# EAGLE board Backplane (EAGLE 7.2.0), part 2 of 2
## Tracks (layer width: path | path; a pad name or v marks a point on that pad's centre or on a via)
1AVAL
  Top 0.254: C22.1 59.97,39.79 R42.1 59.99,40.82 60.45,41.27 66.17,41.27 66.8,41.91 U1.41
2AVAL
  Top 0.254: C24.1 54.1,39.81 R28.1 54.15,41.07 54.99,41.91 65.53,41.91 66.04,42.42 66.04,47.98 U1.40
3AVAL
  Top 0.254: C14.1 65.13,39.79 R7.1 66.91,39.86 67.56,40.51 67.56,47.98 U1.42
+5V  (via drill 0.5, 0.6)
  Top 0.203: v69.95,39.85 70.38,40.03 U13.16 70.38,41.2 70.41,41.17 70.41,41.27 70.31,41.38 70.31,41.07 | 82.07,41.38 81.97,41.28 U14.16 80.7,41.28 v80.59,41.17 | U15.16 94.39,41.28 v94.34,41.22 | U2.8 58.19,79.05 58.37,79.22 v58.37,79.73
  Top 0.254: 34.27,139.24 R49.2 34.27,141.65 R11.2 | U1.28 61.35,53.82 C10.1 61.82,56.06 v61.87,56.11 | U1.7 69.1,54.62 68.94,54.79 68.94,56.26 v68.58,56.62 | R1.2 121.64,54.13 v121.92,53.85 | U3.8 133.58,73.89 v134.49,74.8 | v114.53,34.59 114.53,34.57
  Top 0.305: 34.27,139.24 33.12,139.24 v32.49,139.88 | 34.27,141.65 34.02,141.65 33.88,141.78 | R17.2 42.4,140.88 v42.27,141.02 | R4.2 R3.2 78.83,80.97 v78.79,81
  Bottom 0.203: 80.64,41.12 v80.59,41.17 81,41.58 C16.1 | 94.34,41.12 v94.34,41.22 94.69,41.58 C21.1 | v61.87,56.11 61.87,54.34 C10.1
  Bottom 0.254: v68.58,56.62 68.58,54.95 C11.1 | v121.92,53.85 121.92,53.59 | C15.1 70.07,39.74 v69.95,39.85 | R2.2 76.9,61 JP1.2 | v134.49,74.8 134.49,73.09 C20.1 | U11.8 114.28,34.42 v114.53,34.59 114.82,34.79 C5.1
  Bottom 0.305: v32.49,139.88 32.49,140.13 | v42.27,141.02 42.27,141.15 | v78.79,81 78.79,81.05
  other vias: 139.32,121.18 139.32,119.1 139.32,117.07 139.32,115.04 139.32,112.95 135.25,121.18
  pour Route15 (rank 4): 0,0 142.24,0 142.24,162.56 0,162.56
  pour Top: 139.42,111.84 135.71,111.84 135.51,112.04 135.51,118.19 134.85,118.85 133.99,118.85 133.63,119.2 133.63,121.49 134.19,122.05 139.57,122.05 140.18,121.44 140.18,112.65
  pour Top: 134.7,121.67 134.7,125.22 135.2,125.73 139.01,125.73 139.52,125.22 139.52,121.92 139.27,121.67
+9V  (via drill 0.6)
  Top 0.203: v127.31,91.44 122.53,91.44 121.74,90.65 121.74,80.85 120.6,79.7 88.88,79.7 88.44,80.14 88.44,80.62 v88.42,80.64
  Top 0.254: 138.68,94.29 U9.6 | v136.53,95.76 136.53,95.89 136.4,96.01 | R25.2 117.86,58.59 v117.35,59.11
  Bottom 0.203: 120.55,60.3 120.55,72.57 119.36,73.76 105.61,73.76 104.39,72.54 85.67,72.54 85.29,72.92 85.27,75.06 86.11,75.89 86.11,78.13 88.42,80.44 v88.42,80.64 | R40.1 133.94,92.97 132.94,91.97 127.84,91.97 v127.31,91.44
  Bottom 0.254: R40.1 135.2,95.2 135.51,95.5 136.27,95.5 v136.53,95.76 | v117.35,59.11 119.36,59.11 120.55,60.3
  other vias: 115.54,149.68 22.3,139.09 22.25,137.46 22.2,135.79
  pour Top: 24.97,142.24 21.44,142.34 21.31,134.34 24.99,134.39
  pour Top (rank 2): 114.15,156.77 23.34,156.77 21.18,154.61 21.18,142.42 22.07,141.53 24.87,141.53 25.25,141.91 25.25,151.43 27.41,153.59 111.1,153.72
  pour Top (no thermals): 135.89,94.61 135.89,98.81 133.73,100.97 124.21,100.97 123.57,101.6 123.57,144.78 120.52,147.83 120.52,152.02 121.95,152.12 126.87,146.81 126.87,104.9 127.64,104.14 138.68,104.14 140.84,101.98 140.84,88.52 140.34,88.01 136.65,88.01 135.51,89.15 135.51,94.23
  pour Top (no thermals): 135.31,107.75 135.31,102.95 135.41,102.84 137.67,102.84 137.72,102.79 137.72,107.47 137.21,107.98 135.53,107.98
  pour Top: 111.1,153.8 111.23,148.01 113.18,147.93 120.6,147.93 120.65,147.88 120.65,151.51 121.26,152.12 115.37,152.12 115.34,156.72 114.02,156.72 113.89,156.74
  pour Bottom: 21.18,137.46 21.18,118.97 22.25,117.91 23.01,117.91 23.62,117.3 23.62,93.57 24.49,92.71 26.06,92.71 26.52,93.17 26.52,118.47 25.2,119.79 23.93,119.79 23.47,120.24 23.47,139.09 22.86,139.7 21.54,139.7 21.18,139.34
+24V  (via drill 0.6)
  Top 0.254: R15.2 124.63,58.59 124.97,58.93 124.97,72.14 124.71,72.39 | R14.2 54.32,69.05 JP3.1
  Top 0.61: v137.26,10.39 135.48,10.39 134.21,11.66 134.21,16.74 v134.59,17.12
  Top 0.813: v37.36,67.33 37.36,54.36 v37.16,54.15 | 108.71,70.51 U12.2
  Top 1.016: K1.A1 41.31,44.7 39.29,46.71 39.29,52.02 v37.16,54.15
  Top 1.27: v106.45,71.07 106.5,71.35 106.63,73.03 106.05,71.93 105.77,73.41 105.33,73.84 | v125.68,73.15 125.58,73.15
  Bottom 0.254: 128.5,27.91 128.5,28.78 Q7.1 | R63.2 134.75,26.75 133.83,25.83
  Bottom 0.61: D8.C 35.04,67.14 35.23,67.33 v37.36,67.33 | U7.6 138.91,9.75 138.71,9.96 137.69,9.96 v137.26,10.39 | v134.59,17.12 134.59,25.07 133.83,25.83 129.26,25.83 128.52,26.57 128.52,27.89 128.5,27.91
  Bottom 0.813: K7.A3 v37.16,54.15 35.15,54.15 | 35.15,54.15 35.15,56.07 D5.C | D7.C 35.04,54.04 35.15,54.15 | K8.A3 34.9,67.36 | 34.9,67.36 34.9,65.47 D8.C | 34.9,67.36 34.9,69.25 D6.C
  Bottom 1.016: D1.C 39.22,43.74 40.31,44.83 41.99,44.83 K1.A1
  Bottom 1.27: K8.A3 43.54,67.36 45.19,69.01 47.95,69.01 JP4.1 JP3.1 85.62,69.14 88.11,71.02 105.72,71.02 v106.45,71.07 | Q7.2 Q7.1 127.61,28.85 126.9,29.57 126.9,67.46 125.75,68.61 125.75,73.08 v125.68,73.15
  pour Top (no thermals): 104.52,75.82 104.52,69.72 105.03,69.22 115.19,68.83 115.82,69.47 115.82,71.63 116.84,72.14 117.86,72.14 119.25,72.01 130.81,72.01 131.57,73.15 131.57,77.85 130.18,78.99 107.95,78.74
  pour Bottom: 128.12,30.12 131.01,30.12 131.22,29.92 131.22,27.58 131.14,27.51 128.07,27.51 127.94,27.64 127.94,29.95
AIR-BOT+PRE
  Top 0.254: R19.2 26.86,23.94 26.54,23.62 26.54,21.59 26.42,21.46 26.09,21.46 U6.16
  pour Top (no thermals): 23.88,21.84 26.42,21.84 27.3,20.95 27.3,12.19 24.38,12.19 23.88,12.7
AIR-P
  pour Bottom (no thermals): 52.2,26.42 46.23,26.42 44.58,24.77 44.58,21.08 45.59,20.07 46.74,18.8 47.37,18.16 47.37,13.46 45.97,12.57 44.7,12.7 44.45,12.7 44.45,17.27 43.56,18.54 43.56,28.19 45.09,29.46 52.2,29.46 52.58,29.08 52.58,26.8
AIR-TOP
  Top 0.254: R18.2 20.05,24.02 20.83,23.24 20.83,21.72 21.08,21.46
  pour Top (no thermals): 20.07,12.19 23.11,12.19 23.62,12.7 23.62,21.59 23.37,21.84 20.95,21.84 20.07,20.95
AMD-SEN
  Top 0.254: J1.17 21.65,2.73 21.21,2.29 3.17,2.29 2.29,3.17 2.29,50.29 2.79,50.8 3.43,50.8 3.68,51.05 3.68,52.7 3.05,53.34 3.05,65.02 4.19,66.17 4.19,67.94 3.68,68.45 3.68,98.68 4.32,99.31 20.19,99.31 22.1,101.22 22.1,102.23 22.61,102.74 95,102.74 97.54,105.28 97.54,107.97 U$6.28
B-LIGHT  (via drill 0.6)
  Top 0.254: R61.2 124.38,26.82 125.32,25.88 126.62,25.88 v126.85,25.65
  Bottom 0.254: v126.85,25.65 126.85,23.9 127.13,23.62 Q7.8 | Q7.6 131.52,23.62 131.66,23.76 | Q7.5 131.83,23.62 131.78,23.57
  Bottom 1.676: J2.23 125.5,9.73 128.29,12.52 128.29,22.02 128.88,22.61 131.7,22.61 131.78,22.53 131.78,23.57 131.78,23.65 131.66,23.76 131.6,23.82 129.49,23.82 | Q7.8 128.63,23.82 129.49,23.82 | 129.49,23.82 Q7.7
B-LIGHT-C  (via drill 0.6)
  Top 0.254: U$1.24 87.35,79.78 87.91,79.22 102.59,79.22 103.73,78.08 103.73,74.02 v103.35,73.64
  Bottom 0.254: QE4.1 131.31,34.9 R62.2 131.33,43.83 133.25,45.74 133.25,64.19 129.69,67.74 129.69,74.3 128.8,75.18 104.9,75.18 v103.35,73.64
BMS-P
  pour Top (no thermals): 78.49,12.83 78.49,22.73 80.39,24.64 84.33,24.64 84.71,24.26 84.71,21.59 83.57,20.32 82.3,20.32 81.79,19.81 81.79,12.7 81.03,12.06 79.25,12.06
BOTS-SEN
  Top 0.254: J1.16 17.65,3.55 17.02,2.92 3.56,2.92 2.92,3.56 2.92,49.78 3.3,50.16 3.68,50.16 4.19,50.67 4.19,53.09 3.68,53.59 3.68,64.52 4.95,65.79 4.95,68.2 4.45,68.71 4.45,97.92 5.08,98.55 20.7,98.55 24.26,102.11 97.16,102.11 100.08,105.03 100.08,107.97 U$6.29
BPD-R-SET  (via drill 0.6)
  Top 0.254: v26.34,68.38 10.92,68.38 10.26,69.04 10.26,70.99 9.83,71.42 9.83,87.33 10.11,87.61 21.13,87.61 25.32,91.8 25.32,94 26.62,95.3 88.77,95.33 v89.05,95.05
  Bottom 0.254: R34.2 v26.34,68.38 | v89.05,95.05 88.95,95.17 88.62,95.3 88.62,109.27 U$6.57
BPD-SEN  (via drill 0.5, 0.6)
  Top 0.203: K8.22 26.83,64.36 25.58,65.61 v12.88,65.61
  Top 0.254: U$6.23 84.81,106.27 82.8,104.27 21.08,104.27 20.32,103.5 20.32,101.98 19.18,100.84 3.68,100.84 2.16,99.31 2.16,67.56 v2.67,67.06
  Bottom 0.254: v2.67,67.06 11.38,67.06 | 11.38,67.06 11.51,67 | 11.38,67.06 11.53,66.95 v12.88,65.61
CLEAR  (via drill 0.5)
  Top 0.203: U15.10 103.15,39.12 v103.17,39.09 | v89.59,38.84 89.59,41.26 U14.10 | U13.10 78,38.91 v78.03,38.89
  Bottom 0.203: v103.17,39.09 103.12,38.84 v89.59,38.84 v78.03,38.89
CLK  (via drill 0.5)
  Top 0.203: U15.11 101.88,38.05 v101.8,37.97 | U14.11 88.27,41.26 v88.27,37.97 88.27,37.31 88.06,37.11 86.33,37.11 85.88,37.57 77.01,37.57 | U13.11 76.73,37.85 77.01,37.57 | 77.01,37.57 76.91,37.57
  Top 0.254: 76.71,41.66 76.73,41.63 U13.11 76.45,41.51 76.45,49.78 73.22,53.02 U1.5
  Bottom 0.203: v101.8,37.97 v88.27,37.97
CSENSE  (via drill 0.6)
  Top 0.254: U3.7 135.76,72.14 v136.75,73.13 | v89.84,76.07 89.84,69.42 v90.12,69.14 | U1.19 63.7,59.72 63.7,63.73 64.9,64.92 81.64,64.92 82.6,65.89 82.6,66.93 v82.53,67
  Bottom 0.254: v136.75,73.13 136.75,77.11 136.17,77.7 131.65,77.7 131.62,77.72 91.49,77.72 v89.84,76.07 | v90.12,69.14 87.96,69.14 86.23,67.41 82.93,67.41 v82.53,67
DATA-IN
  Top 0.254: U13.14 72.9,41.26 72.9,42.42 73.91,43.43 73.91,49.02 72.31,50.62 U1.2
DDS-P
  pour Top (no thermals): 100.08,24.26 100.46,24.64 104.65,24.64 105.79,23.5 105.79,12.95 105.16,12.32 103.25,12.32 102.74,12.83 102.74,19.56 102.23,19.94 100.84,21.08 100.2,21.59 100.2,24.13
ECU-RELAY  (via drill 0.6)
  Top 0.254: v26.59,47.37 8.26,47.37 6.35,49.28 6.35,53.98 5.84,54.48 5.84,63.02 7.14,64.31 7.14,69.7 6.96,69.88 6.96,90.4 7.57,91.01 19.89,91.01 21.64,92.76 21.64,96.04 24.97,99.54 90.04,99.54 v90.45,99.92
  Bottom 0.254: R33.2 33.01,45.91 32.46,46.46 27.51,46.46 v26.59,47.37 | v90.45,99.92 90.45,92.08 91.14,91.39 91.14,88.92 U$1.25
ECU-SEN
  Top 0.203: 26.77,37.19 K1.22 28.52,38.94 28.52,51.54
  Top 0.254: 28.52,51.54 28.52,52.3 27.71,53.11 14.99,53.11 12.34,55.75 6.83,55.75 6.53,56.06 6.53,62.59 7.92,63.98 7.92,70.16 7.64,70.43 7.64,89.43 8.33,90.12 20.19,90.12 22.66,92.58 22.66,95.99 25.43,98.78 99.34,98.75 102.56,101.42 102.56,107.97 U$6.30
FAN
  pour Bottom (no thermals): 43.05,11.05 43.05,8.51 44.58,8 49.15,8.13 49.78,8.76 49.78,10.29 51.56,12.06 52.58,12.06 53.09,12.57 53.09,19.3 53.72,19.94 53.72,23.62 53.09,24.26 50.16,24.26 49.78,23.88 49.78,20.19 50.29,19.68 50.29,13.59 48.13,11.43 43.43,11.43
FROM-TSMS  (via drill 0.5, 0.6)
  Top 0.254: v54.97,92.84 52.58,92.84 52.4,92.66 28.14,92.66 27.53,92.05 27.53,83.67 v29.41,81.79 | v15.62,31.42 19.05,31.42 20.19,30.28 20.19,27.89 v20.45,27.64
  Bottom 0.254: U$6.12 56.87,105.99 55.42,104.55 55.42,93.29 v54.97,92.84 | v29.41,81.79 29.41,78.44 28.14,77.17 13.54,77.17 11.86,75.49 11.86,70.05 12.42,69.49 14.88,69.49 15.49,68.89 15.49,66.45 13.92,64.87 13.92,54.28 14.71,53.49 14.71,32.33 v15.62,31.42 | v20.45,27.64 20.62,27.64 20.73,27.74
  other vias: 22.86,24.38 23.75,23.88 22.86,23.37 24.64,24.38 24.64,23.37 25.53,23.88 21.97,23.88
  pour Bottom (no thermals): 28.19,13.21 28.19,18.03 26.92,19.3 19.56,19.3 19.05,19.81 19.05,27.43 19.81,28.19 30.23,28.19 30.99,27.43 30.99,12.95 28.45,12.95
GND  (via drill 0.5, 0.6)
  Top 0.203: v92.18,41.12 92.13,41.12 | U8.4 100.2,31.63 98.68,33.15 98.68,36.7 99.06,37.08 103.96,37.08 v104.34,37.47 | U10.4 85.21,34.67 85.09,34.8 85.09,36.7 84.71,37.08 81.03,37.08 80.77,36.83 80.77,35.94 v80.52,35.69 80.46,35.63 U13.8 | U14.8 92.45,35.68 v92.58,35.81 | U5.4 75.56,31.37 73.53,33.4 73.53,36.58 73.91,36.96
  Top 0.254: R51.1 36.3,140.39 v36.04,140.64 R16.1 | R48.1 46.2,140.26 46.46,140 47.98,140 v48.23,139.75 | v32.59,51.44 32.54,51.38 | v29.44,73.94 29.44,73.89 | U1.29 61.39,53.02 C10.2 61.82,50.72 v61.77,50.67 | U1.6 69.15,53.82 C11.2 68.43,51.28 v68.17,51.03 | v32.13,37.41 32.13,36.2 29.9,33.96 25.7,33.96 24.79,33.05 24.79,30.84 24,30.04 U6.4 | LED8.C 16.22,23.97 v15.88,23.62 | LED9.C 31.02,23.84 v31.37,23.5 | LED17.C 104.85,32.46 v104.9,32.51 | LED14.C 95.91,32.16 v96.01,32.26 | LED5.C v88.77,32 | LED4.C v81.28,32 | LED12.C LED10.C 63.21,22.95 63.63,23.37 64.24,23.37 v64.47,23.57 | VIN.C 121.67,64.96 5V.C 119.93,64.98 119.89,65.02 119.37,65.02 9V.C 118.04,64.96 v117.09,64.01 | VCCIO.C 109.47,58.42 108.46,57.4 108.46,52.99 U12.1 | v73.91,37.59 73.91,36.96 | LED6.C LED3.C | R54.1 48.27,58.41 48.01,58.67 | C14.2 63.16,37.97 R41.2 63.16,36.92 63.12,36.96 61.85,36.96 v61.72,37.08 | C22.2 57.99,37.01 | R57.2 57.99,35.73 57.99,37.01 | C24.2 52.09,35.73 R60.2 52.16,36.99 52.07,37.08 v50.8,37.08 | 57.99,37.01 57.91,37.08 v56.64,37.08 | U2.5 58.47,82.86 v58.67,82.65 | LED11.C 124.38,41.07 v124.41,41.1 | R13.1 60.73,63.01 C27.2 60.64,63.01 60.66,62.99 60.66,62.05 v61.24,61.47 | v106.5,24.23 106.5,24.28 106.53,24.31 | v115.24,37.74 115.24,37.77 115.27,37.8 | U12.3 99.72,65.53 | R8.1 10.8,39.89 C26.2 20.91,39.97 21.79,39.09 21.79,37.26 K1.21 | C25.2 38.9,25.2 R21.2 38.81,25.2 39.22,24.79 39.22,30.48 v39.37,30.63 | U15.8 104.42,37.39 v104.34,37.47
  Top 0.305: U3.5 135.64,69.6 v135.89,69.34 136.06,69.51 C28.2 | 104.44,37.36 v104.34,37.47 | LED3.C 45.8,54.36 v45.8,55.8
  Top 0.406: U12.3 99.52,65.58 99.34,65.53 99.24,65.43 | Q2.2 48.19,58.37 R54.1 | 48.27,58.41 48.27,60.95 47.88,61.34 45.77,61.34 v45.8,62.66 | v138.99,11.15 139.01,11.15 139.12,11.05
  Top 0.61: C4.C 88.04,159 v87.73,159.31 | v29.03,60.38 29.08,60.38 | v32.89,65.41 32.94,65.35 | Q1.2 52.13,59.88 52.2,60.07 | 52.2,60.07 v53.34,60.07 | R52.1 52.16,59.52 52.2,60.07
  Top 0.813: v36.85,44.42 36.85,44.48 36.91,44.53 | 105.33,49.07 105.89,48.51 106.17,48.79 106.17,49.02 106.12,49.07 C7.C | C12.C 132.28,126.11 v131.9,126.49 | C8.C 129.13,83.54 130.05,84.45 130.05,93.97 U9.1 | v131.95,96.67 131.95,96.01 130.3,94.36
  Top 1.016: U9.3 137.09,81.64 v136.75,81.97
  Top 1.27: C1.C 117.07,63.99 v117.09,64.01
  Bottom 0.203: C21.2 103.48,41.58 104.44,40.62 104.44,37.57 v104.34,37.47 | C16.2 91.72,41.58 v92.18,41.12 | v61.77,50.67 61.77,52.54 C10.2 | SJ1.3 32.33,40.01 32.69,39.65 36.2,39.65 36.35,39.8 36.35,40.41 Q10.2 | v80.52,35.69 80.52,35.56 | v92.58,35.81 92.46,35.69
  Bottom 0.254: v36.04,140.64 36.04,140.77 | v48.23,139.75 48.36,139.62 | R36.1 32.33,63.69 Q13.2 | 32.33,73.09 Q12.2 | v68.17,51.03 68.17,52.85 C11.2 | v32.13,37.41 32.08,37.41 32.03,37.47 | v15.88,23.62 16,23.75 | v31.37,23.5 31.24,23.62 | v104.9,32.51 104.78,32.38 | v96.01,32.26 96.01,32.13 | v88.77,32 88.77,32.13 | v81.28,32 81.28,32.13 | v64.47,23.57 64.47,23.55 | v117.09,64.01 116.84,64.01 | C15.2 73.33,38.18 v73.91,37.59 | v50.8,37.08 50.8,37.21 | v56.64,37.08 56.64,37.21 | v61.72,37.08 61.85,36.96 | v58.67,82.65 58.73,82.65 | QE4.2 133.21,34.85 R62.1 139.09,34.92 v139.55,34.47 | v124.41,41.1 124.38,41.1 124.33,41.15 | v61.24,61.47 61.32,61.47 61.37,61.52 | U11.5 114.07,29.64 110.59,26.16 110.59,24.49 110.11,24 106.73,24 v106.5,24.23 | C5.2 115.81,36.17 C13.2 115.16,36.17 115.47,36.47 115.47,37.52 v115.24,37.74 | R24.2 98.28,67.29 97.77,66.78 v97.77,66.22 | v39.37,30.63 39.37,30.68
  Bottom 0.305: R39.2 135.23,82.22 135.48,81.97 v136.75,81.97 | Q10.2 36.56,40.73 R30.1 36.56,40.78 36.55,40.77 | 135.99,69.34 v135.89,69.34 135.64,69.6 134.57,69.6 134.21,69.95 C20.2 | v45.8,55.8 45.82,55.5
  Bottom 0.406: R35.1 32.33,49.72 Q6.2 | v45.8,62.66 45.77,62.64 | U7.3 138.91,11.23 v138.99,11.15
  Bottom 0.61: v87.73,159.31 87.73,159.56 | 32.33,73.09 R29.1 30.29,73.09 v29.44,73.94 | 32.33,49.72 32.33,51.17 v32.59,51.44 | R31.1 30.89,59.93 Q4.2 29.48,59.93 v29.03,60.38 | 32.33,63.69 32.33,64.84 v32.89,65.41
  Bottom 0.813: 36.55,40.77 36.55,44.12 v36.85,44.42 | v131.9,126.49 132.16,126.24
  Bottom 1.016: v136.75,81.97 136.75,81.84
  other vias: 113.74,157.99 139.04,44.75 137.77,44.75 138.28,43.48 139.55,43.48 139.55,42.21 138.28,42.21 139.55,40.94 139.55,39.67 139.55,38.4 139.55,37.13 140.34,56.46 140.34,58.9 140.44,65.81 140.36,49.96 118.8,70.21 135.31,109.45 134.19,110.41 133.38,109.19 132.46,110.46 131.5,109.35 130.53,110.52 118.8,68.78 96.19,147.04 98.68,147.09 101.27,146.94 93.75,136.37 105.44,136.22 105.38,146.53 92.74,146.74 139.55,35.86 111.63,51.03 111.63,49.76 129.92,96.67 97.76,64.8
  pour Route2: 0.53,-0.2 142.24,0 142.24,162.56 0,162.56
  pour Top (no thermals): 135.74,33.32 135.74,41.96 135.23,42.47 135.23,44.75 135.74,45.26 139.55,45.26 140.06,44.75 140.06,33.32
  pour Top: 134.47,49.2 134.47,66.22 134.85,66.6 140.69,66.6 141.2,66.09 141.2,49.53 140.41,48.69 134.98,48.69
  pour Top: 118.31,70.46 118.57,70.71 124.26,70.71 124.38,70.59 124.38,68.17 124.26,68.05 118.69,68.05 118.31,68.43
  pour Top (rank 4): 131.93,95.81 131.93,93.01 131.29,92.63 129.51,92.63 129.01,92.89 129.01,97.46 129.49,96.06 131.78,96.06
  pour Top (rank 4): 131.93,96.95 131.93,93.4 131.29,92.76 129.51,92.76 129.01,93.27 129.01,96.82 129.39,97.21 131.67,97.21
  pour Top (rank 4): 132.18,96.95 132.18,93.4 131.55,92.76 129.77,92.76 129.26,93.27 129.26,96.82 129.64,97.21 131.93,97.21
  pour Top (rank 4): 131.93,96.95 131.93,93.4 131.29,92.76 129.51,92.76 129.01,93.27 129.01,96.82 129.39,97.21 131.67,97.21
  pour Top (rank 4): 132.56,96.95 132.56,93.4 131.93,92.76 130.15,92.76 129.64,93.27 129.51,96.7 130.02,97.21 132.31,97.21
  pour Top: 111.89,48.21 105.33,47.96 104.98,48.31 104.98,53.64 105.54,54.2 111.84,54.2 112.14,53.9 112.14,48.46
  pour Top (no thermals): 133.22,117.93 133.22,114.27 132.77,113.82 132.77,111.33 129.72,111.33 129.72,108.48 132.77,108.48 132.77,106.05 134.8,106.05 134.8,108.69 138.15,108.69 138.15,111.28 134.95,111.28 134.85,111.38 134.85,117.47 134.39,117.93
  pour Top (no thermals): 133.22,117.93 133.22,114.27 132.77,113.82 132.77,111.33 129.72,111.33 129.72,108.48 132.82,108.48 132.77,106.05 134.8,106.05 134.8,108.64 138.15,108.64 138.15,111.28 134.95,111.28 134.85,111.38 134.85,117.47 134.39,117.93
  pour Top: 92.23,149.73 106.15,149.73 106.15,135.31 92.23,135.31
  pour Top (no thermals): 127.76,19.68 127.76,24.89 129.29,26.42 134.37,26.42 135.76,27.81 135.76,33.78 136.02,34.04 139.7,34.04 140.08,33.66 140.08,26.16 138.68,24.77 137.16,23.5 134.75,21.08 134.75,19.56 134.24,19.05 128.4,19.05
  pour Top (no thermals): 97.33,66.73 100.66,66.73 100.91,66.47 100.91,64.24 100.61,63.93 97.43,63.93 97.18,64.19 97.18,66.57
H-EN  (via drill 0.6)
  Top 0.254: U$1.23 84.81,79.07 85.75,78.13 101.7,78.13 102.67,77.17 102.67,75.13 v102.29,74.75 102.29,74.8 | 102.29,74.8 102.31,74.83 102.29,74.83 102.29,74.8
  Bottom 0.254: U7.8 U7.1 136.37,15.9 137.29,16.82 140.46,16.82 140.82,17.17 140.82,45.54 140.54,45.82 134.11,45.82 133.96,45.97 | 133.96,64.95 131.17,67.74 131.17,74.07 128.88,76.35 103.89,76.35 v102.29,74.75
  Bottom 0.305: 133.96,64.95 133.96,45.97
H-SIG  (via drill 0.6)
  Top 0.254: U$1.22 82.27,78.13 83.01,77.39 100.28,77.39 v101.5,76.17 101.52,76.17 101.47,76.12
  Bottom 0.254: 137.97,15.72 140.72,15.72 141.4,16.41 141.4,45.82 140.84,46.38 135.69,46.38 134.93,47.14 134.93,65.51 132.41,68.02 132.41,74.47 129.9,76.99 102.29,76.96 v101.5,76.17
  Bottom 0.406: U7.2 137.64,15.39 137.97,15.72 139.75,15.72 140.13,15.34 140.13,13.51 U7.4
HCMESURE  (via drill 0.6)
  Top 0.203: U1.31 58.41,51.42 58.27,51.28 58.27,48.34 58.52,48.08 v59.28,48.08
  Bottom 0.203: v59.28,48.08 63.4,48.08 64.21,47.27 64.21,46.1 64.72,45.59 85.9,45.59 87.1,46.79 87.1,50.09 87.86,50.85 87.86,65.13 89.2,66.47 95,66.47 97.21,68.68 113.44,68.68 114.94,67.18
  Bottom 0.254: U11.7 112.88,32.18 112.65,32.41 112.65,34.65 113.16,35.15 113.16,54.86 114.94,56.64 114.94,67.18
HORN+
  Bottom 0.406: R44.2 124.98,4.95 J2.35
HORN-
  Bottom 0.406: R45.2 121.03,3.17 120.14,4.06 120.14,5.66 J2.34
IMD-INPUT  (via drill 0.5, 0.6)
  Top 0.254: v5.36,30.35 5.31,30.35 4.75,30.91 4.75,49 5.56,49.81 5.56,53.85 5.18,54.23 5.18,63.45 6.53,64.8 6.53,69.14 6.17,69.49 6.17,91.64 6.6,92.08 19.81,92.08 20.95,93.22 20.95,96.47 24.94,100.61 61.77,100.61 v61.95,100.48 61.92,100.41
  Bottom 0.254: J1.13 35.65,26.66 32.74,29.57 6.15,29.57 v5.36,30.35 | v61.95,100.48 U$6.14
IMD-R-SET  (via drill 0.6)
  Top 0.254: v27.03,54.69 14.55,54.69 12.85,56.39 12.85,56.41 12.7,56.57 7.52,56.57 7.24,56.84 7.24,62.18 8.56,63.5 8.56,70.61 8.36,70.81 8.36,88.8 8.76,89.2 20.52,89.2 23.5,92.2 23.5,95.38 25.83,97.69 v92.33,97.69
  Bottom 0.254: R32.2 27.19,54.52 v27.03,54.69 | v92.33,97.69 92.41,105.61 91.16,106.96 91.16,109.22 U$6.58
IMD-SEN  (via drill 0.6)
  Top 0.254: v12.83,52.05 24.83,52.05 K7.22 | U$6.24 87.35,105.77 84.96,103.38 21.59,103.38 21.08,102.87 21.08,101.22 19.94,100.08 3.94,100.08 2.92,99.06 2.92,68.2 3.68,67.44 3.68,66.67 2.29,65.28 2.29,52.32 v2.67,51.94
  Bottom 0.254: v2.67,51.94 12.72,51.94 v12.83,52.05
IS-SEN
  Top 0.254: U$6.22 82.27,106.27 81.15,105.16 24.64,105.16 23.37,106.43 3.68,106.43 1.52,104.27 1.52,2.92 2.79,1.65 24.77,1.65 25.65,2.54 J1.18
LAT  (via drill 0.5)
  Top 0.203: U13.12 75.46,38.86 v75.44,38.79 | v86.94,37.97 87,37.97 87,41.26 U14.12 | U15.12 100.61,38.3 100.43,38.12 97.69,38.12 97.43,37.87 v97.43,37.11
  Top 0.254: U13.12 75.46,49.76 73,52.22 U1.4
  Bottom 0.203: v75.44,38.79 75.44,37.92 v86.94,37.97 86.94,37.11 v97.43,37.11
LED1
  Top 0.203: U1.22
  Top 0.254: U1.22 60.12,60.71 R53.2 56.26,60.71 55.88,60.33 55.88,56.77 55.37,56.26 53.21,56.26 52.75,55.8 R20.2
LED2
  Top 0.203: 59.38,57.84 U1.23
  Top 0.254: U1.23 58.8,58.42 R55.2 56.9,58.4 56.9,56.52 55.88,55.5 54.48,55.5 54.1,55.12 54.1,52.7 53.66,52.26 R10.2
LOOP-IN
  Bottom 1.676: K1.11 21.38,44.7 19.41,42.72 19.34,42.72 19.09,42.47 19.09,35.06 21.77,32.38 34.01,32.38 37.77,28.63 37.77,13.82 J1.6
MAIN  (via drill 0.6)
  Top 0.254: U6.8 22,33.91 23.04,34.95 29.41,34.95 30.07,35.61 30.07,38.38 30.94,39.24 42.52,39.24 43.92,40.64 43.92,72.26 43.2,72.97 33.27,72.97 31.83,74.42 31.83,78.79 31.62,78.99 28.55,78.99 26.09,81.41 26.09,93.52 26.87,94.31 v50.09,94.34
  Bottom 0.254: 51.79,108.05 U$6.10 51.79,95.99 v50.09,94.34
MCS-P
  pour Top (no thermals): 85.14,24.26 85.47,24.64 88.77,24.64 89.79,23.62 89.79,12.83 89.28,12.32 87.12,12.32 86.61,12.83 86.61,20.07 85.14,21.59
N$1
  Top 0.254: R56.1 113.52,58.47 VCCIO.A
N$2
  Top 0.254: LED8.A 19.76,26.07 R18.1
N$3
  Top 0.406: U$2.4 131.88,114.94 R6.2 132.02,117.15 C2.1 132.07,119.38 R5.1
N$4
  Top 0.203: U14.1 81.94,32.99 83.19,31.75 83.19,29.44 U10.8
N$5
  Top 1.93: U$5.33 U$5.1 U$5.2 U$5.34
  pour Top (no thermals): 26.77,141.91 31.98,141.91 32.49,142.42 32.49,151.69 32.11,152.07 28.04,152.07 27.66,151.69 27.66,145.97 26.77,145.08
N$6
  Bottom 0.254: R32.1 29.31,57.96 29.39,58.04 30.8,58.04 R31.2 32.33,58.08 Q4.1
N$7
  Bottom 1.676: K7.11 20.87,57.9 19.41,56.44 19.41,47.38 K1.14
N$8
  Top 0.254: R25.1 9V.A
N$9
  pour Bottom (no thermals): 27.58,116.03 27.58,107.29 28.19,106.68 31.7,106.68 32,106.98 32,115.57 31.09,116.48 28.04,116.48
N$10
  Top 0.254: R19.1 LED9.A
N$11  (via drill 0.6)
  Top 0.254: U6.7 22.5,30.2 v22.96,30.66 | v32.56,30.71 32.56,26.29 33.73,25.12 34.64,25.12 R21.1 R43.2
  Bottom 0.254: v22.96,30.66 32.51,30.66 v32.56,30.71
N$12
  pour Bottom (no thermals): 27.79,96.01 27.79,86.92 28.35,86.36 31.39,86.36 31.85,86.82 31.85,95.3 30.94,96.22 27.99,96.22
N$13
  Top 1.93: U$4.34 U$4.2 U$4.1 U$4.33
  pour Top (no thermals): 28.3,128.57 28.3,132.77 26.77,134.29 26.77,137.97 27.03,138.23 31.98,138.23 32.23,137.97 32.23,129.08 31.72,128.57
N$14  (via drill 0.6)
  Top 0.203: 30.35,33.4 32.99,36.04 33.66,36.04 34.27,36.65 v34.27,36.91
  Top 0.254: U6.2 25,29.8 25.53,30.33 25.53,32.59 26.06,33.12 30.07,33.12 30.35,33.4
  Bottom 0.203: v34.27,36.91 34.27,37.41 33.2,38.48 30.91,38.48 30.71,38.68 30.71,39.95 SJ1.2
N$15
  Bottom 1.676: K8.11 19.85,71.11 19.15,70.41 19.15,60.33 K7.14
N$16
  Top 0.254: LED3.A 50.74,54.36 R20.1
N$17
  pour Top (no thermals): 67.82,29.97 67.82,24.64 68.2,24.26 68.2,21.34 68.71,20.95 74.17,20.95 75.06,21.84 75.06,24.26 74.68,24.64 71.5,24.64 70.99,25.15 70.99,29.46 70.1,30.35 68.2,30.35
N$18
  Top 0.305: U3.6 135.79,70.87 136.14,71.22 137.78,71.22 C28.1
N$19
  Top 0.254: 5V.A R1.1
N$20
  Top 0.406: U$5.30 102.54,148.64 JP7.1
N$21
  Top 0.61: JP3.2 52.02,66.34 51.21,65.53 Q1.3
N$22
  Top 0.61: JP4.2 48.08,63.15 Q2.3
N$23
  Bottom 0.254: R38.2 29.31,48.06 29.54,47.83 30.75,47.83 R35.2 32.33,47.92 Q6.1
N$24
  Top 0.305: LED1.A 76.7,79.25 R3.1
N$25
  Top 0.305: LED2.A R4.1
N$26
  Top 0.254: R53.1 54.86,60.71 54.36,61.21 50.42,61.21 50.16,60.96 50.16,60.28 Q1.1 50.23,58.37 R52.2
N$27
  Top 0.254: Q2.1 46.29,58.32 R54.2 46.27,57.36 46.74,56.9 54.48,56.9 54.86,57.28 54.86,58.4 R55.1
N$28
  Top 0.254: R22.1 65.34,21.87 LED10.A
N$29
  Top 0.254: LED12.A R27.1
N$30
  pour Top (no thermals): 125.58,71.17 130.66,71.17 130.66,64.82 132,63.47 132,47.12 134.16,44.58 125.6,44.53 125.6,55.3 125.55,58.14 125.55,60.68
  pour Top (no thermals): 126.75,27.43 134.11,27.43 134.87,28.19 134.87,41.4 134.24,42.42 134.24,44.58 132.72,45.72 126.87,45.72 125.73,44.58 125.73,28.45
N$31
  Top 0.254: U5.7 74.06,28.21 73.79,27.94 72.9,27.94 72.64,28.19 72.64,30.23 69.47,33.4 69.47,35.05 68.83,35.69 R41.1 65.16,37.82 R7.2
N$32
  Bottom 0.254: QE4.3 132.26,28.88 Q7.4 134.61,28.85 R63.1
N$33
  Top 0.203: U14.2 83.21,32.49 84.2,31.5 U10.6
N$34
  Top 0.254: R61.1 LED11.A
N$35
  Bottom 0.203: R26.2 C3.1
N$36
  Top 0.203: U14.3 84.48,31.98 84.71,31.75 U10.5
N$37  (via drill 0.5)
  Top 0.203: v105.08,63.5 103.1,63.5 102.64,63.04 102.64,61.82 102.29,61.47 99.67,61.47 U12.4
  Bottom 0.203: R24.1 102.89,63.61 C3.2 105.02,63.56 v105.08,63.5
N$38
  Top 0.406: U$5.29 100,148.64 JP7.2
N$39
  Top 0.203: U14.4 85.75,29.45 U10.3
N$40
  Top 0.254: U1.17 65.2,60.88 65.86,61.54 72.97,61.54 74.17,60.35 74.17,55.96 74.6,55.52 77.29,55.52 JP1.4
N$41
  Bottom 0.254: U$4.38 42.9,129.59 42.9,91.49 U$1.38
N$42
  Top 0.254: VIN.A R15.1
N$43
  Top 0.254: U1.16 66,60.72 66.32,61.04 72.54,61.04 73.46,60.12 73.46,54.51 75.08,52.88 77.5,52.88 JP1.5
N$44
  Top 0.203: U14.5 87.02,34.57 86.23,33.78 86.23,29.44 U10.2
N$45
  Bottom 1.016: K1.A2 42.11,37.21 39.8,37.21 39.22,37.8 D1.A 35.69,38.55 Q10.3
N$46
  Top 0.254: JP1.1 75.49,63.12 74.83,62.46 65.76,62.46 64.41,61.11 64.41,59.63 U1.18
  Bottom 0.254: R2.1 77.25,62.8 JP1.1
N$47
  Bottom 0.61: Q4.3 39.27,58.98 39.85,58.4 39.85,58.24 40.31,57.78
  Bottom 0.813: K7.A1 40.43,57.9 40.31,57.78 39.98,57.45 39.98,56.33 D5.A
N$48
  Bottom 0.305: R33.1 34.76,44.09 R30.2 34.76,40.73 Q10.1
N$49
  Bottom 0.61: Q6.3 39.12,48.82 39.9,49.61 39.9,49.88 40.43,50.4
  Bottom 0.813: K7.A2 40.43,50.4 39.98,50.85 39.98,51.98 D7.A
N$50
  Bottom 0.61: Q12.3 38.84,72.19 39.92,71.11
  Bottom 0.813: K8.A1 39.92,71.11 39.73,70.92 39.73,69.51 D6.A
N$51
  Bottom 0.61: Q13.3 39.61,62.79 40.43,63.61
  Bottom 0.813: K8.A2 40.43,63.61 39.98,64.06 39.98,65.19 D8.A
N$52
  Bottom 0.406: R44.1 136.27,4.95 137.67,6.35 137.67,8.2 U7.7
N$53
  Bottom 0.406: R45.1 138.81,3.17 140.21,4.57 140.21,8.2 U7.5
N$54
  Top 0.254: LED6.A 50.7,52.32 R10.1
N$55
  Bottom 0.254: R37.2 30.97,65.21 30.76,65 29.79,65 29.44,64.64 29.44,62.26 29.74,61.95 30.77,61.95 R36.2 32.33,61.89 Q13.1
N$56
  Top 0.406: U$5.28 97.46,148.64 JP7.3
N$57
  Bottom 0.254: U$4.37 40.36,129.59 40.36,91.49 U$1.37
N$58
  Bottom 0.254: Q12.1 32.33,71.29 R29.2 30.84,71.22 31.01,71.04 31.01,68.42 R34.1
N$59
  Bottom 0.305: C9.1 R40.2
N$60  (via drill 0.5)
  Top 0.305: U9.4 137.13,85.65 v137.01,85.78
  Bottom 0.305: v137.01,85.78 135.5,85.78 R39.1 135.23,87.26 C9.2
N$61
  pour Bottom (no thermals): 117.6,32 122.17,32 122.94,32.77 122.94,49.78 120.9,51.82 114.55,51.82 114.3,51.31 114.81,42.16 118.87,41.91 118.87,36.58 117.6,35.56
N$62
  Top 0.203: U14.6 88.29,34.95 86.74,33.4 86.74,29.44 U10.1
N$63
  Bottom 0.254: U11.6 112.45,30.91 112.09,31.27 112.09,35.42 C13.1
N$64
  Top 0.203: U15.1 95.53,34.14 98.17,31.5 98.17,29.44 U8.8
N$65
  Top 0.203: U15.2 96.8,33.5 99.19,31.11 99.19,29.43 U8.6
N$66
  Top 0.203: U15.3 98.07,32.87 99.69,31.24 U8.5
N$67
  Top 0.254: R46.1 LED4.A
N$68
  Top 0.254: LED5.A R47.1
N$69  (via drill 0.6)
  Top 0.254: U10.7 83.71,28.09 83.57,27.94 82.55,27.94 82.42,28.07 82.42,29.21 82.17,29.46 79.88,29.46 79.63,29.21 79.63,25.15 v78.87,24.38 | v61.47,34.54 61.47,35.31 61.09,35.69 R57.1 59.99,35.72 R42.2
  Bottom 0.254: v78.87,24.38 72.26,24.38 71.37,25.27 71.37,31.75 69.34,33.78 61.98,33.78 v61.47,34.54
N$70
  Top 0.203: U15.4 99.34,33.63 100.71,32.26 U8.3
N$71
  Top 0.203: U15.5 100.61,32.99 101.22,32.38 101.22,29.44 U8.2
N$72
  Top 0.203: U15.6 101.88,34.95 101.73,34.8 101.73,29.44 U8.1
N$73
  Top 0.203: U13.1 70.38,33.76 73.53,30.61 73.53,29.44 U5.8
N$74
  Top 0.203: U13.2 71.65,33.88 74.55,30.99 U5.6
N$75
  Top 0.203: U13.3 72.92,33.25 75.06,31.11 U5.5
N$76
  Top 0.203: U13.4 74.19,33.38 76.07,31.5 76.07,29.43 U5.3
N$77
  Top 0.203: U13.5 75.46,32.87 76.58,31.75 76.58,29.44 U5.2
N$78
  Top 0.203: U13.6 76.73,32.49 77.09,32.13 77.09,29.44 U5.1
N$79
  Top 0.203: U15.14 98.07,40.39 97.69,40.01 93.4,40.01 93.24,40.16 93.24,41.73 92.79,42.24 85.37,42.24 85.11,42.04 85.11,40.46 84.35,39.65 79.76,39.65 79.27,40.13 U13.9
N$80
  Top 0.203: U15.9 104.42,42.47 104.24,42.65 84.76,42.65 84.45,42.34 84.45,41.31 U14.14
N$81
  Top 0.406: U$5.27 94.92,148.64 JP7.4
N$83
  Top 0.254: LED14.A 95.91,26.55 R58.1
N$84
  Top 0.254: LED17.A R59.1
N$85  (via drill 0.6)
  Top 0.254: R28.2 R60.1 54.19,35.69 55.24,35.69 56.21,34.87 v56.21,33.98 | U8.7 98.7,28.09 98.55,27.94 97.41,27.94 97.16,28.19 97.16,29.34 96.9,29.59 93.73,29.59 93.34,29.21 93.34,24.64 v92.96,24.26
  Bottom 0.254: v92.96,24.26 80.77,24.26 79.88,23.37 72.64,23.37 70.87,25.15 70.87,31.37 68.96,33.27 56.87,33.25 v56.21,33.98
OUTEN  (via drill 0.5)
  Top 0.203: U13.13 74.19,39.83 v74.22,39.75 | v99.31,39.65 99.31,41.26 U15.13 | U14.13 85.75,39.73 v85.72,39.7
  Top 0.254: U13.13 74.17,41.26 74.17,42.16 74.68,42.67 74.68,49.53 72.78,51.42 U1.3
  Bottom 0.203: 78.41,39.73 v74.22,39.75 74.17,39.7 | 78.41,39.73 84.86,39.7 | 84.86,39.7 v85.72,39.7 | v85.72,39.7 v99.31,39.65 | v85.72,39.7 84.86,39.7 | 78.46,39.78 78.41,39.73
P+F
  pour Bottom (no thermals): 44.07,6.22 44.2,4.45 44.83,3.81 55.5,3.68 57.78,5.97 57.78,29.84 57.53,30.1 54.99,30.1 54.23,29.34 54.23,11.68 54.99,10.92 54.99,8 53.47,6.48 49.02,6.48 48.39,7.11 44.96,7.11
PRE+  (via drill 0.6)
  Top 0.254: U6.1 25.5,29.28 26.16,29.95 26.16,31.93 26.57,32.33 43.38,32.33 44.88,33.83 44.88,73.33 44.32,73.89 33.81,73.89 32.82,74.88 32.82,79.22 32.05,79.98 28.88,79.98 26.75,82.04 26.75,92.66 27.46,93.45 51.36,93.45 52.27,94.13 v58.75,94.13
  Bottom 0.254: U$6.13 59.41,94.79 v58.75,94.13
RAVAL
  Top 0.254: R43.1 39.36,22.76 C25.1
RELAY-SET  (via drill 0.6)
  Top 0.254: v31.37,53.57 31.37,65.91 30.71,66.57 27.3,66.57 v27.25,66.52 15.65,66.52 14.5,67.67 10.08,67.67 9.32,68.43 9.32,70.79 9.04,71.07 9.04,88.01 9.45,88.42 20.73,88.42 24.38,92.08 24.38,94.84 26.34,96.52 98.63,96.5 103.94,100.79 103.94,104.52 104.8,105.39 109.96,105.39 110.69,106.12 110.69,111.61 109.88,112.42 95.43,112.42 94.89,111.89 94.89,110.62 U$6.59
  Bottom 0.254: R37.1 27.33,66.6 v27.25,66.52 | R38.1 31.07,53.27 v31.37,53.57
RS1-A  (via drill 0.6)
  Top 0.203: J2.6 104.17,11.12 J2.8
  Top 0.254: R11.1 34.14,144.92 R12.2 34.2,148.45 U$5.3 | v34.01,126.19 33.91,126.09 23.42,126.09 21.61,127.89 21.26,128.25 20.68,128.83 7.52,128.83 6.88,128.19 JP5.1 | U$1.3 34.01,75.92 35.23,74.7 45.74,74.7 48.13,72.31 80.54,72.31 84.02,68.83 84.02,45.85 85.32,44.55 105.74,44.55 107.59,42.7 107.59,14.34 J2.8
  Bottom 0.203: 34.04,136.8 34.01,136.83
  Bottom 0.254: U$5.3 34.01,136.83 34.01,133.27 32.74,131.88 32.74,129.59 U$4.3 v34.01,126.19 34.01,112.85 32.69,111.53 32.69,109.32 U$6.3 34.01,93.73 32.77,92.48 32.77,88.92 U$1.3
RS1-B  (via drill 0.6)
  Top 0.203: 37.92,139.83 37.82,139.72 | J2.17 102.18,7.11 J2.19
  Top 0.254: R16.2 36.04,144.94 R12.1 36,148.09 U$5.4 37.82,147.37 37.82,139.72 37.82,128.32 U$4.4 v36.55,124.54 36.5,124.59 30.5,124.59 | v36.55,113.21 35.26,111.91 35.26,109.3 U$6.4 | 30.23,124.59 30.5,124.59 | 30.5,124.59 30.48,124.61 23.04,124.61 20.04,127.61 11.89,127.61 9.98,125.7 6.4,125.7 JP5.2 | U$1.4 36.55,76.81 37.72,75.64 46.48,75.64 48.82,73.3 81.03,73.3 85.11,69.22 85.11,46.41 85.95,45.57 105.87,45.57 108.51,42.93 108.51,16.97 110.21,15.27 110.21,12.57 109.4,11.76 106.66,11.76 105.87,10.97 105.87,10.07 J2.19
  Bottom 0.203: 106.2,9.74 J2.19
  Bottom 0.254: v36.55,124.54 v36.55,113.21 | U$6.4 36.55,92.02 35.26,90.73 35.26,88.98 U$1.4
RS2-A  (via drill 0.6)
  Top 0.254: R17.1 44.42,144.69 R23.2 44.41,148.4 U$5.7 | v45.44,121.79 45.09,121.44 21.18,121.44 20.5,122.12 20.5,125.86 19.51,126.85 12.19,126.85 11.2,125.86 11.2,123.67 10.69,123.17 6.66,123.17 JP5.3 | U$1.7 v44.17,82.5 44.17,77.06 44.73,76.5 46.86,76.5 49.15,74.22 81.46,74.22 86.18,69.49 86.18,47.35 87.07,46.25 106.2,46.25 109.45,43.2 109.42,17.73 v109.37,17.63 | U2.6 54.48,81.58 v54.2,81.86
  Bottom 0.254: U$6.7 44.42,108 | U$5.7 44.17,133.15 45.44,131.88 45.44,129.59 U$4.7 45.44,127.05 v45.44,121.79 45.44,109.27 U$6.7 | U$6.7 44.17,92.33 45.41,91.08 45.41,88.92 U$1.7 | v109.37,17.63 93.34,17.65 92.2,16.51 | 92.2,16.51 92.08,16.38 92.15,13.79 J2.4 | v54.2,81.86 44.81,81.86 v44.17,82.5 | J2.2 84.21,15.48 85.7,16.97 91.75,16.97 92.2,16.51
RS2-B  (via drill 0.6)
  Top 0.203: J2.13 86.08,7.21 J2.15
  Top 0.254: R48.2 R23.1 46.21,148.14 U$5.8 | v47.98,120.6 47.93,120.65 32.44,120.65 7.11,120.62 JP5.4 | U$1.8 v46.71,80.11 46.71,77.93 49.45,75.18 81.92,75.18 87.35,69.75 87.35,48.36 88.49,46.94 106.76,46.94 110.29,43.69 v110.29,16.51 | U2.7 54.59,80.31 v54.33,80.06
  Bottom 0.203: 90.25,9.77 J2.15
  Bottom 0.254: U$6.8 46.97,108 | U$5.8 46.71,133.15 47.98,131.88 47.98,129.59 U$4.8 47.98,127.05 v47.98,120.6 47.98,109.27 U$6.8 | U$6.8 46.71,92.66 47.95,91.29 47.95,88.95 U$1.8 | v110.29,16.51 94.97,16.48 94.18,15.7 | 94.18,15.7 94.28,15.82 94.18,15.72 94.18,15.7 | 94.18,15.7 94.18,12.52 93.32,11.66 91.08,11.66 90.14,10.72 90.14,9.79 J2.15 | v54.33,80.06 46.76,80.06 v46.71,80.11
RS3-A
  Top 0.254: R49.1 34.27,135.55 R50.2 34.38,131.23 U$4.35
  Bottom 0.254: U$4.35 35.28,129.59 35.28,107.21 35.26,107.19 35.26,91.47 U$1.35
RS3-B
  Top 0.254: R51.2 36.18,137.47 R50.1 36.18,131.23 U$4.36
  Bottom 0.254: U$4.36 37.82,129.59 37.82,91.49 U$1.36
RX  (via drill 0.6)
  Top 0.203: U2.1 66.87,79.05 LED1.C
  Top 0.254: 66.87,79.05 66.32,79.05 66.24,79.12 66.45,79.12 66.5,79.17 66.5,80.54 v66.65,80.7 | U1.1 71.89,49.82 72.42,49.3 v72.42,48.46 | v72.95,66.98 v72.95,71.25
  Bottom 0.254: v72.42,48.46 72.42,66.45 v72.95,66.98 | v72.95,71.25 72.95,82.65 71.3,84.3 63.91,84.3 63.7,84.1 63.7,82.68 64.8,81.58 65.76,81.58 v66.65,80.7
SAS-P
  pour Top (no thermals): 94.49,12.57 94.49,22.99 96.01,24.51 99.44,24.51 99.69,24.26 99.69,21.59 97.79,19.68 97.79,12.7 97.03,12.06 95.12,12.06
SSW_C_SEN  (via drill 0.6)
  Top 0.254: 89.92,107.97 U$6.25 88.65,109.25 88.65,113.61 87.53,114.68 32.61,114.68 32.08,114.15 v22.3,114.15
  Bottom 0.254: J1.10 23.65,2.82 23.24,2.41 4.57,2.41 2.92,4.06 2.92,46.1 1.4,47.62 1.4,103.76 3.94,106.3 20.75,106.3 22.05,107.59 22.05,113.89 v22.3,114.15
SSW_L-SEN  (via drill 0.6)
  Top 0.254: U$6.27 93.7,109.22 93.7,114.43 92.28,115.9 31.88,115.9 31.45,115.47 v20.98,115.47
  Bottom 0.254: J1.11 27.65,2.5 26.92,1.78 4.06,1.78 2.29,3.56 2.29,45.72 0.76,47.24 0.76,104.39 3.43,107.06 | 95,107.97 U$6.27
  Bottom 0.406: 3.43,107.06 19.99,107.06 21.13,108.2 21.13,115.32 v20.98,115.47
SSW_R-SEN  (via drill 0.6)
  Top 0.254: J1.9 17.2,9.7 14.73,7.24 14.73,4.19 14.22,3.68 4.19,3.68 3.81,4.06 3.81,49.15 4.83,50.16 4.83,53.47 4.45,53.85 4.45,64.01 5.71,65.28 5.71,68.71 5.33,69.09 5.33,97.16 5.97,97.79 21.08,97.79 24.64,101.35 93.42,101.35 93.75,101.02 v93.75,100.58
  Bottom 0.254: U$6.26 92.43,107.54 93.83,106.15 93.83,100.66 v93.75,100.58
TO-TSMS
  Bottom 1.676: K8.14 16.73,72.94 18.52,74.73 23.47,74.73 24.23,73.97 24.23,35.41 24.33,35.41 24.51,35.23 24.56,35.23 24.71,35.08 38.18,35.08 41.78,31.47 41.78,13.84 J1.7
TSA  (via drill 0.6)
  Top 0.254: U$4.11 54.46,128.19 54.46,119.66 v54.2,119.41 46.43,119.41 45.87,119.96 9.86,119.96 7.98,118.08 6.66,118.08 JP5.5 | v86.46,74.42 86.46,72.11 88.32,70.26 88.32,49.63 v88.92,49.02
  Bottom 0.254: J2.25 84.21,2.94 | 84.21,2.94 85.19,1.96 103.35,1.96 104.24,2.85 104.24,5.7 J2.30 | v54.2,119.41 54.2,114.88 55.12,113.97 112.85,113.97 113.82,113 113.82,82.32 111.99,80.49 89.89,80.49 87.45,78.05 87.45,75.23 v86.46,74.42 | v88.92,49.02 88.92,44.6 88.09,43.76 58.55,43.76 54.66,39.88 54.66,32.31 55.14,31.83 64.8,31.83 65.81,30.79 65.81,17.93 66.4,17.37 76.28,17.37 77.24,16.41 77.24,3.94 78.31,2.87 84.14,2.87 84.21,2.94
TSB  (via drill 0.6)
  Top 0.254: U$4.12 57,128.19 57,119.51 v55.91,118.42 46.35,118.42 45.41,119.36 10.62,119.36 10.24,118.97 10.24,116.97 8.81,115.55 6.4,115.55 JP5.6 | v87.73,73.48 87.73,72.08 89.03,70.79 89.03,50.77 v90.65,49.15
  Bottom 0.254: J2.26 88.21,5.18 | 88.21,5.18 88.21,3.38 88.88,2.72 99.8,2.72 100.31,3.23 100.31,5.63 J2.29 | v55.91,118.42 55.91,115.42 56.69,114.63 113.23,114.63 114.58,113.28 114.58,82.19 112.34,79.96 90.63,79.96 88.14,77.47 88.14,73.89 v87.73,73.48 | v90.65,49.15 90.65,48.95 89.59,47.88 89.59,44.3 88.44,43.16 59.05,43.16 55.24,39.34 55.24,32.66 55.47,32.44 65.02,32.44 66.42,31.04 66.42,18.26 66.7,17.98 76.66,17.98 77.95,16.69 77.95,8.36 78.44,7.87 80.95,7.87 81.33,7.7 85.09,7.7 85.65,7.42 87.38,7.42 88.16,6.63 88.16,5.23 88.21,5.18
TSMS-SEN
  Top 0.254: U$6.21 79.73,106.53 79.25,106.05 24.89,106.05 23.62,107.31 3.68,107.31 0.89,104.52 0.89,2.54 2.41,1.02 28.32,1.02 29.59,2.29 29.59,5.64 J1.19
TSS-P
  Top 0.254: R27.2 75.69,19.68 76.2,20.19
  Top 1.422: 80.21,6.3 J2.24 80.21,3.51 81,2.72 95.61,2.72 96.24,3.35 96.24,5.7 J2.28
  pour Top (no thermals): 79.25,10.16 79.76,9.65 79.76,7.62 81.28,6.1 81.28,3.81 81.03,3.56 76.96,3.56 76.2,4.32 76.2,10.16
  pour Top (no thermals): 75.56,24.51 77.6,24.51 77.85,24.26 77.85,12.7 79.76,10.79 79.76,9.65 79.38,9.78 76.71,9.78 75.51,11.05 75.51,24.38
TX  (via drill 0.6)
  Top 0.203: U2.4 66.74,82.86 LED2.C
  Top 0.254: LED2.C 67,82.53 66.7,82.83 v65.08,82.83 | U1.44 70.7,48.02 v71.3,47.42 | v71.48,67.03 71.48,70.99 v71.17,71.3
  Bottom 0.254: v71.3,47.42 71.3,66.85 v71.48,67.03 | v71.17,71.3 71.17,81.56 70.05,82.68 65.23,82.68 v65.08,82.83
U2-CNT  (via drill 0.6)
  Top 0.254: U2.3 61.65,80.95 | 61.65,80.95 U2.2 | U1.43 68.4,49.48 68.28,49.61 66.6,49.61 v66.34,49.86 | v63.91,80.95 61.65,80.95 | v66.8,67.16 66.8,71.02 v66.7,71.12
  Bottom 0.254: 66.4,49.86 v66.34,49.86 66.34,66.7 v66.8,67.16 | v66.7,71.12 66.7,77.65 65.84,78.51 64.24,78.51 63.83,78.92 63.83,80.87 v63.91,80.95
VCCIO  (via drill 0.5, 0.6)
  Top 0.203: 86.36,26.42 v85.85,25.91 85.85,26.04 85.6,26.29
  Top 0.254: v86.74,26.42 86.36,26.42 v85.85,26.92 | 85.6,26.29 85.6,26.42 85.72,26.54 | R56.2 106.17,60.45 105.16,59.44 105.16,58.42 104.65,57.91 100.18,57.91 U12.5 | v104.6,56.19 100.94,56.19 | 75.92,26.72 76.12,26.72 v76.33,26.92
  Top 0.406: 75.92,26.72 75.51,26.31 | U5.EP 76.12,26.72 75.51,26.11
  Top 0.813: C7.A 98.27,50.85 v97.16,51.97
  Bottom 0.254: R26.1 102.95,56.57 103.23,56.29 104.5,56.29 v104.6,56.19
  Bottom 0.406: U5.EP 76.02,26.31 76.33,26.67
  other vias: 97.16,53.34 97.16,54.71 97.16,56.08 97.16,57.45 96.14,52.63 96.14,54.05 96.14,55.37 96.14,56.74 96.14,58.22 96.14,51.21 74.3,25.91 75.31,26.42 77.34,26.42 76.33,25.91 73.28,26.42 74.3,26.92 84.96,26.42 84.07,25.91 84.07,26.92 83.19,26.42 99.95,26.42 100.84,26.92 100.84,25.91 99.06,26.92 99.06,25.91 98.17,26.42 101.73,26.42 95.12,57.45 95.12,56.06 95.12,54.79 95.12,53.26 95.12,51.87
  pour Top: 100.97,51.38 100.97,58.5 100.2,59.26 95.02,59.26 94.26,58.5 94.26,51.51 94.89,50.88 100.46,50.88
  pour Bottom: 72.14,30.23 104.65,30.23 106.43,32 106.43,49.02 104.78,50.67 94.49,50.67 93.98,51.18 93.98,58.67 95,59.69 100.58,59.69 101.47,58.8 101.47,55.5 102.36,54.61 107.44,54.61 110.49,51.56 110.49,28.07 107.7,25.27 72.77,25.27 72.14,25.91
VGND
  Bottom 1.27: C23.2 120.64,14.16 J2.11
  pour Top (no thermals): 117.22,24 125.22,24 126.24,22.99 126.24,12.83 125.48,12.06 119.13,12.06 118.49,12.7 118.49,18.03 116.71,19.81 116.71,23.5
VIN
  Bottom 1.27: C23.1 116.74,14.26 J2.10
  pour Bottom (no thermals): 111.12,12.7 115.95,12.7 116.71,13.46 116.71,14.22 117.47,14.99
  pour Bottom (no thermals): 111.25,12.32 116.33,12.32 117.47,13.46 117.47,15.75 118.11,16.38 118.11,25.02 119.38,26.29 121.67,27.94 122.3,28.57 122.3,30.99 121.92,31.37 117.22,31.37 116.33,30.48 116.33,29.34 115.32,28.32 112.78,26.42 111.51,25.27 111.51,12.57
  pour Top (no thermals): 111,12.32 117.09,12.32 117.6,12.83 117.6,17.02 116.08,18.54 116.08,25.15 116.97,26.04 120.4,26.04 121.54,27.18 121.54,31.62 120.65,32.51 112.65,32.51 111,30.86
VSENSE
  Top 0.254: R13.2 59,64.96 C27.1 | R13.2 R14.1 | R13.2 62.25,64.96 62.87,64.34 62.87,59.69 U1.20
VSENSE2
  Top 0.254: R9.1 R8.2 8.61,41.77 C26.1

## Text on the board
tPlace: IS | TM | SS | ECU | RJ
_tsilk: C4 | R12 | R23 | IS | R11 | R17 | F1 | R16 | R48 | R51 | R49 | R50 | F4 | JP5 | C12 | TM | R5 | C2 | R6 | U50 | SS | U9 | ECU | C8 | LED2 | R4 | + | LED1 | U2 | R3 | + | C18 | C19 | K8 | U3 | C28 | C27 | R14 | 9V | 5V | VIN | C1 | Q2 | Q1 | R53 | R13 | C17 | + | + | + | K7 | VCCIO | R56 | + | R25 | R1 | R15 | R54 | R52 | R55 | RJ | C6 | + | LED3 | + | U1 | U12 | R20 | JP1 | LED6 | K1 | R10 | C7 | X1 | V1 | R9 | C24 | R28 | C22 | R42 | C14 | R7 | D3 | C26 | R8 | R61 | LED11 | D9 | + | R60 | R41 | U14 | U15 | R57 | U13 | L1 | U5 | U10 | U8 | U6 | + | LED4 | LED5 | LED14 | LED17 | + | X2 | + | + | + | + | R21 | R46 | R47 | R59 | LED8 | R18 | R19 | LED9 | R58 | R43 | C25 | + | R22 | R27 | LED10 | LED12 | +
_bsilk: F2 | F3 | R40 | C9 | R39 | R29 | Q12 | C20 | D6 | R34 | R37 | R24 | Q13 | C3 | R36 | D8 | R2 | Q4 | D5 | R26 | R31 | R32 | C10 | C11 | D7 | Q6 | R38 | R35 | R33 | R30 | C16 | C21 | SJ1 | D1 | Q10 | C15 | C13 | C5 | R62 | Q7 | QE4 | R63 | U11 | C23 | U7 | R44 | R45